# EasyEDA Pro project BLDCV6.eprj, board PCB1_1
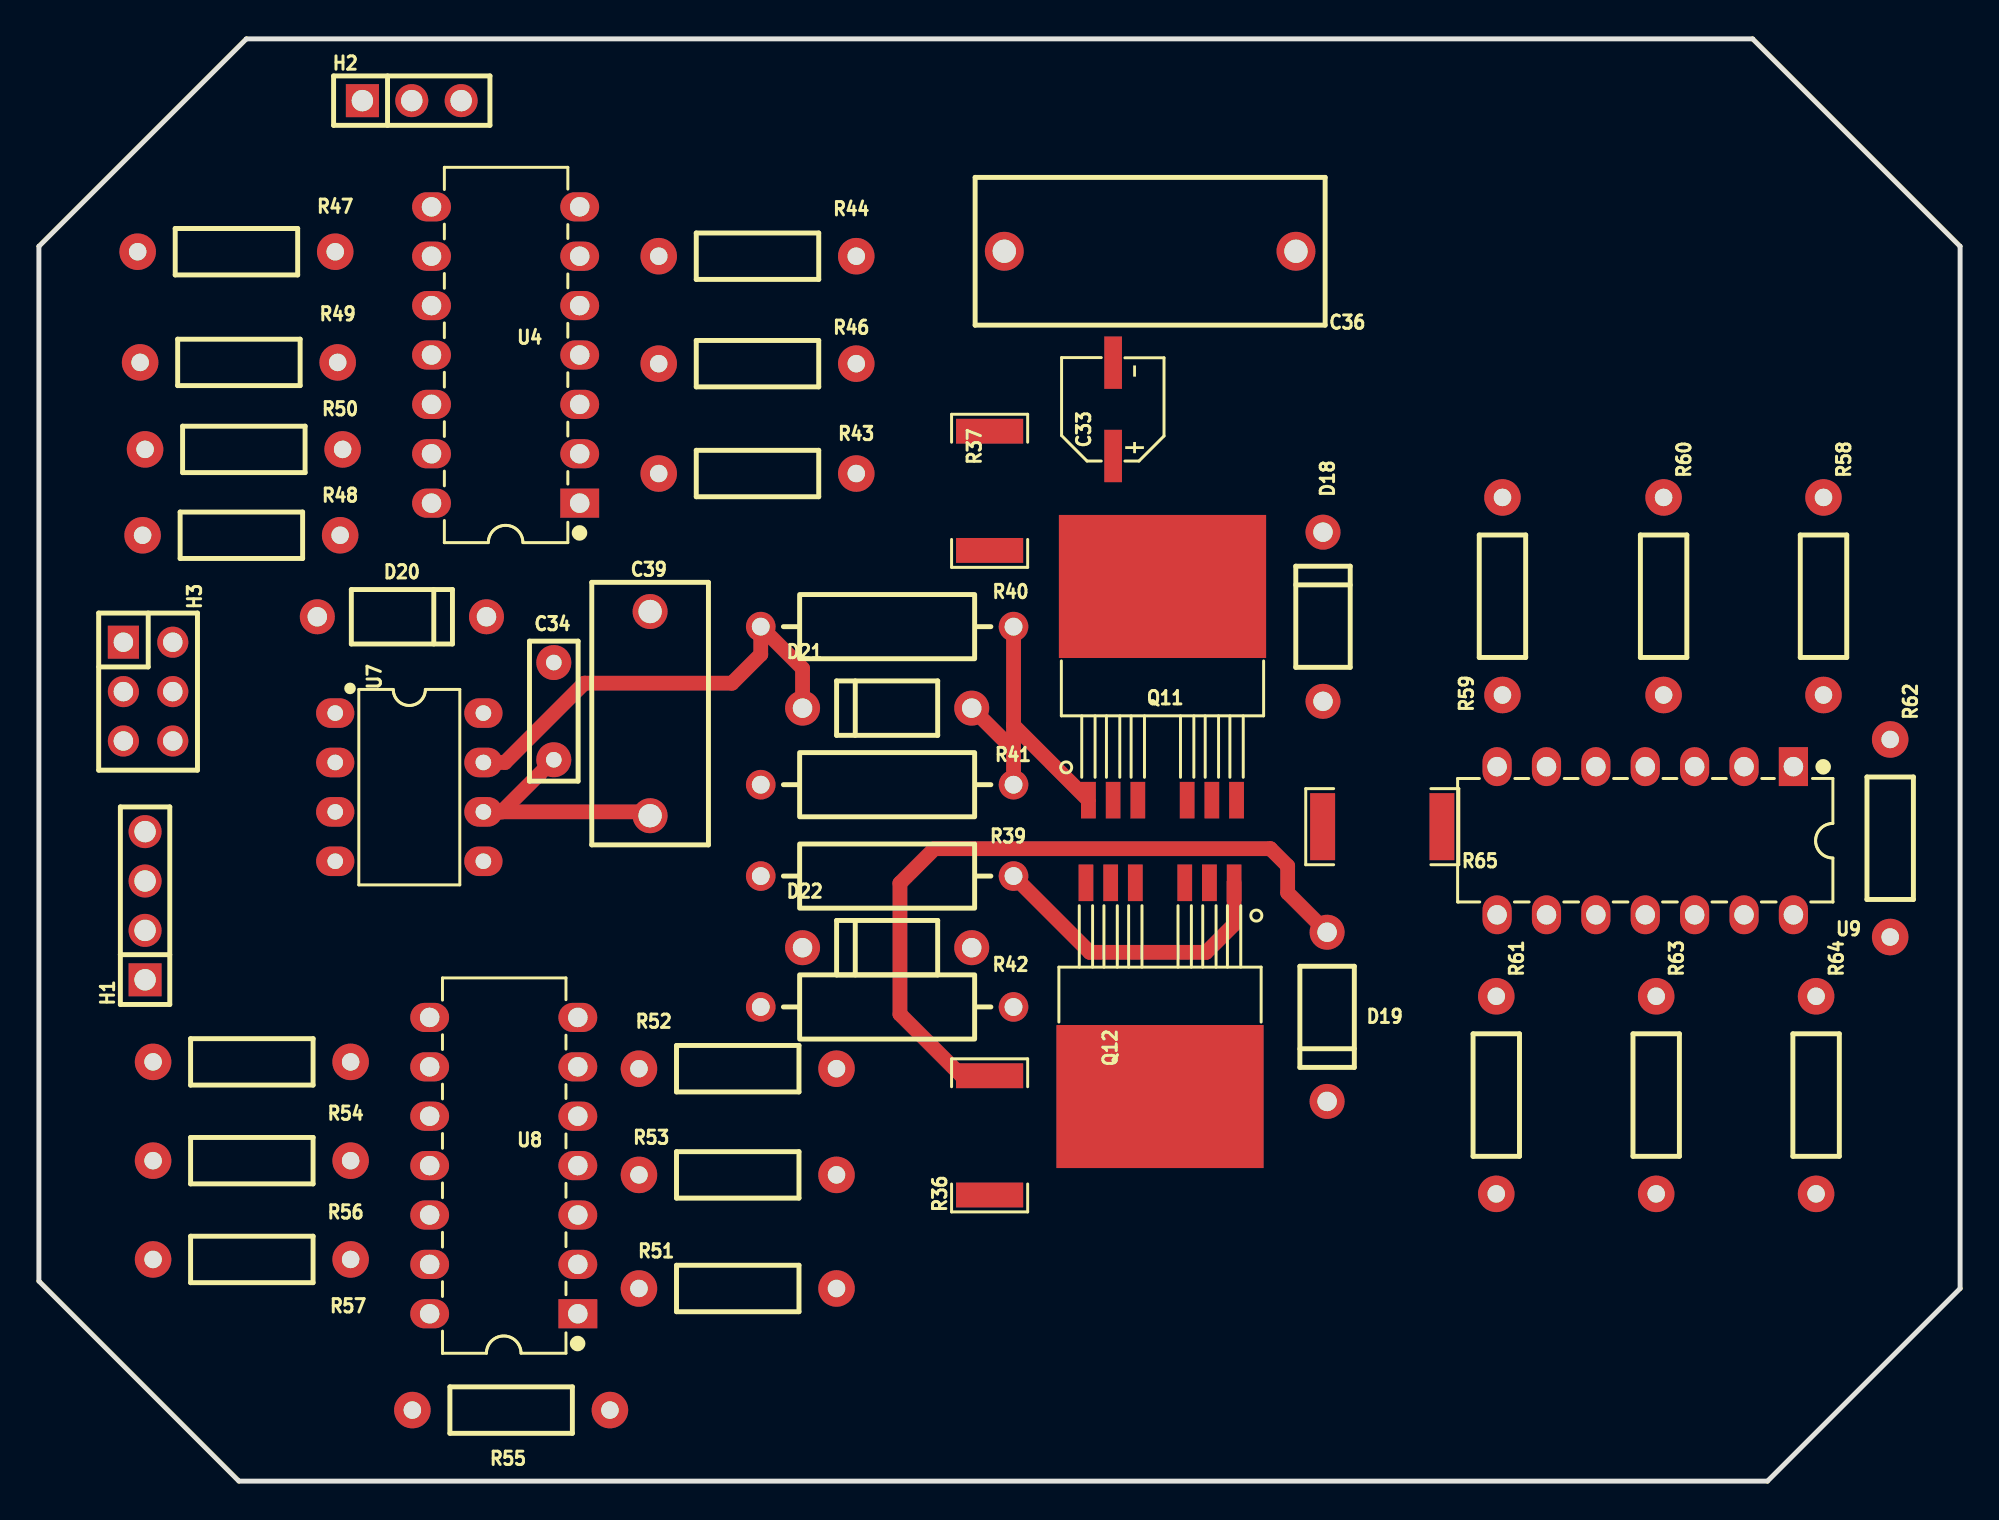
[diagram p15: board, top side]
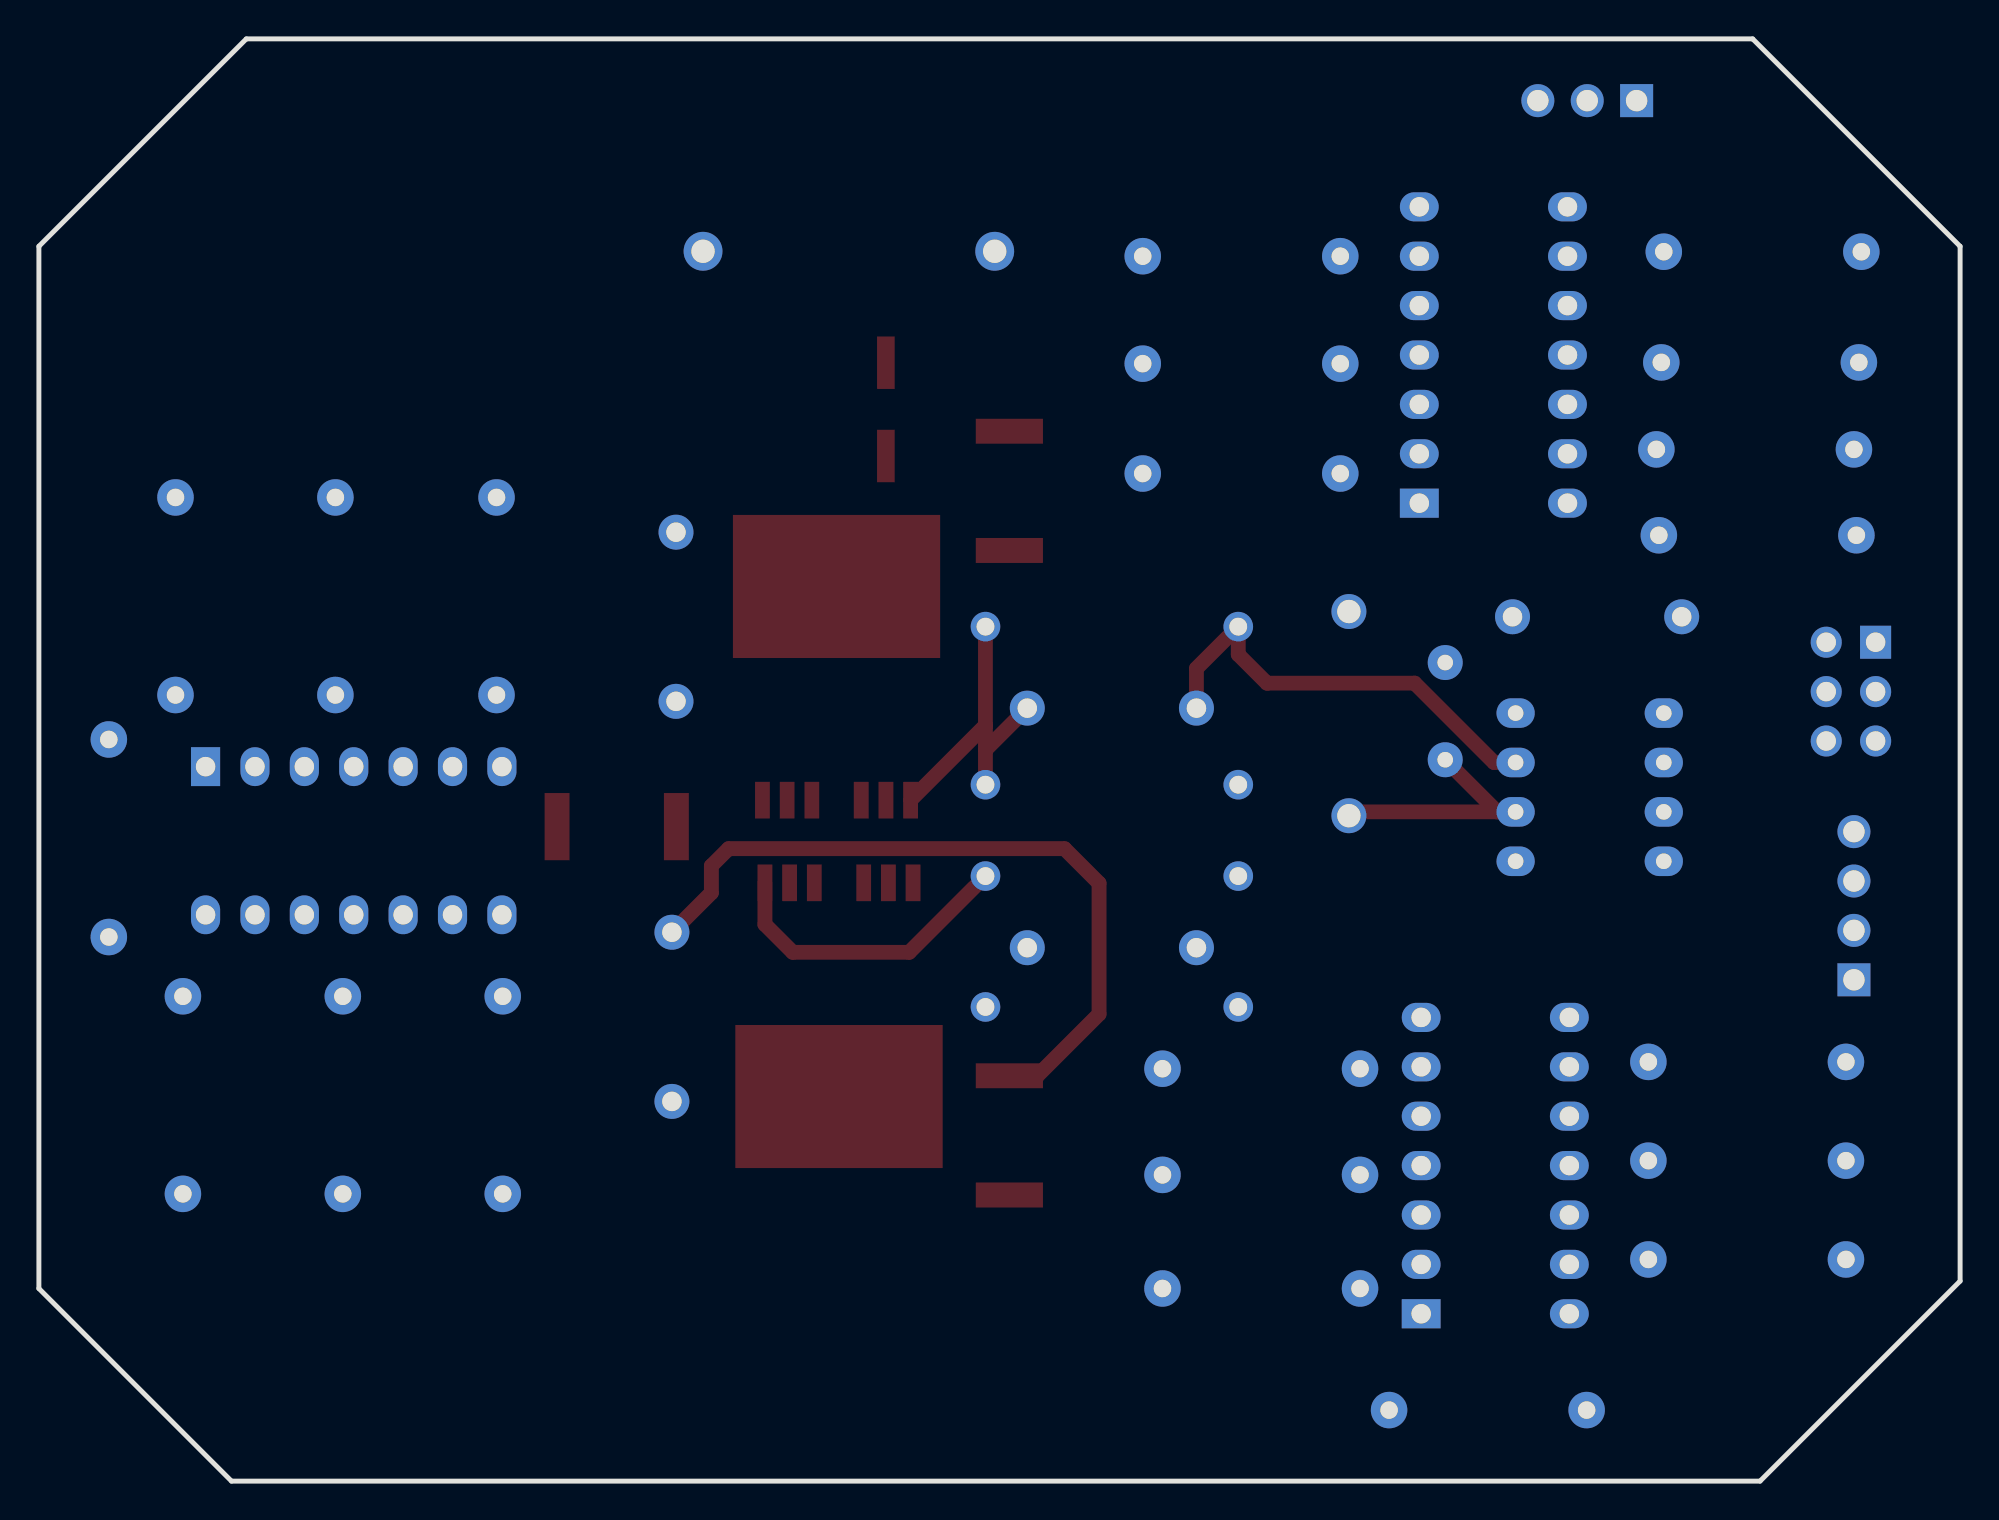
[diagram p16: board, bottom side, seen from below]

Outline 98.81 x 74.17 mm; copper layers: Top Layer, GND, Inner2, Bottom Layer. Coordinates in mm from the lower left corner of the outline.
Outline path: 0,63.5 0,10.29 10.29,0 88.9,0 98.81,9.91 98.81,63.5 88.14,74.17 10.67,74.17 0,63.5
Stack: Top Layer 0.035mm 外层铜厚1oz / Dielectric1 0.2104mm 7628 RC49% 8.6mil / GND 0.0152mm 内层铜厚 / Dielectric2 1.065mm 1.1mm H/HOZ 含铜 / Inner2 0.0152mm 内层铜厚 / Dielectric3 0.2104mm 7628 RC49% 8.6mil / Bottom Layer 0.035mm 外层铜厚1oz

## Design rules (mm)
template: JLCPCB Capability(Two Layers Board)
spacing copperThickness1oz (default): track to track 0.102, other pairs 0.152 to 0.3
spacing copperThickness2oz: track to track 0.203, other pairs 0.152 to 0.3
track width copperThickness1oz (default): min 0.127, default 0.254, max 2.54
track width copperThickness2oz: min 0.203, default 0.254, max 2.54
differential pair differentialPair (default): width min 0.127, default 0.254, max 2.54; gap min 0.152, default 0.152
via viaSize (default): diameter min 0.5, default 0.61, max 10; hole min 0.3, default 0.305, max 6.3

## Placement (name value [footprint] x y rotation side)
C33  10uF  [CAP-SMD_BD5.0-L5.3-W5.3-LS6.3-FD]  55.24 55.12 90 top
C34  1uF  [CAP-TH_L7.2-W2.5-P5.00-D0.6]  26.48 39.6 90 top
C36  330nF  [CAP-TH_L18.0-W7.5-P15.00-D0.8]  57.15 63.25 180 top
C39  15nF  [CAP-TH_L13.5-W5.5-P10.50-D1.2]  31.43 39.47 90 top
D18  -  [DO-41_BD2.4-L4.7-P8.70-D0.9-RD]  66.04 44.45 270 top
D19  -  [DO-41_BD2.4-L4.7-P8.70-D0.9-RD]  66.25 23.88 90 top
D20  -  [DO-41_BD2.4-L4.7-P8.70-D0.9-RD]  18.67 44.45 180 top
D21  -  [DO-41_BD2.4-L4.7-P8.70-D0.9-RD]  43.62 39.75 0 top
D22  -  [DO-41_BD2.4-L4.7-P8.70-D0.9-RD]  43.62 27.43 0 top
H1  -  [HDR-TH_4P-P2.54-V-M]  5.46 29.59 90 top
H2  -  [HDR-TH_3P-P2.54-V-M]  19.18 70.99 0 top
H3  -  [HDR-TH_6P-P2.54-V-F-R2-C3-S2.54]  5.62 40.6 270 top
Q11  IRFS7530TRL7PP  [D2PAK-7_L10.6-W9.6-P1.27-LS15.9-BR]  57.79 40.51 270 top
Q12  IRFS7530TRL7PP  [D2PAK-7_L10.6-W9.6-P1.27-LS15.9-BR]  57.66 25.27 90 top
R36  5mΩ  [R2512]  48.89 17.78 90 top
R37  5mΩ  [R2512]  48.89 50.93 90 top
R39  [6-10]  [RES-TH_BD3.3-L9.0-P13.00-D0.6]  43.62 31.11 0 top
R40  [6-10]  [RES-TH_BD3.3-L9.0-P13.00-D0.6]  43.62 43.94 180 top
R41  10k  [RES-TH_BD3.3-L9.0-P13.00-D0.6]  43.62 35.81 180 top
R42  10k  [RES-TH_BD3.3-L9.0-P13.00-D0.6]  43.62 24.38 180 top
R43  10kΩ  [R_AXIAL-0.4]  36.96 51.82 180 top
R44  10kΩ  [R_AXIAL-0.4]  36.96 62.99 180 top
R46  10kΩ  [R_AXIAL-0.4]  36.96 57.47 0 top
R47  10kΩ  [R_AXIAL-0.4]  10.16 63.22 0 top
R48  10kΩ  [R_AXIAL-0.4]  10.41 48.64 180 top
R49  10kΩ  [R_AXIAL-0.4]  10.29 57.53 180 top
R50  10kΩ  [R_AXIAL-0.4]  10.54 53.06 180 top
R51  10kΩ  [R_AXIAL-0.4]  35.94 9.91 0 top
R52  10kΩ  [R_AXIAL-0.4]  35.94 21.21 180 top
R53  10kΩ  [R_AXIAL-0.4]  35.94 15.75 0 top
R54  10kΩ  [R_AXIAL-0.4]  10.95 21.56 180 top
R55  10kΩ  [R_AXIAL-0.4]  24.29 3.65 180 top
R56  10kΩ  [R_AXIAL-0.4]  10.95 16.48 180 top
R57  10kΩ  [R_AXIAL-0.4]  10.95 11.4 180 top
R58  10kΩ  [R_AXIAL-0.4]  91.78 45.51 270 top
R59  10kΩ  [R_AXIAL-0.4]  75.27 45.51 90 top
R60  10kΩ  [R_AXIAL-0.4]  83.56 45.51 270 top
R61  10kΩ  [R_AXIAL-0.4]  74.95 19.85 270 top
R62  10kΩ  [R_AXIAL-0.4]  95.21 33.06 270 top
R63  10kΩ  [R_AXIAL-0.4]  83.18 19.85 270 top
R64  10kΩ  [R_AXIAL-0.4]  91.4 19.85 270 top
R65  5mΩ  [R2512]  69.09 33.65 180 top
U4  LM324N  [DIP-14_L19.3-W7.0-P2.54-LS7.6-BL]  24 57.91 90 top
U7  IR2104PBF  [DIP-8_L9.9-W6.6-P2.54-LS7.62-BL]  19.05 35.69 270 top
U8  LM324N  [DIP-14_L19.3-W7.0-P2.54-LS7.6-BL]  23.91 16.23 90 top
U9  LM324N  [DIP-14_L19.3-W7.0-P2.54-LS7.6-BL]  82.61 32.93 180 top

## Footprints (pads in the part's own frame, mm; a bottom-side part is the same pattern mirrored in y, then rotated)
CAP-SMD_BD5.0-L5.3-W5.3-LS6.3-FD
  rect 2.7x0.91 smd: 1(-2.4,0) 2(2.4,0)
CAP-TH_L7.2-W2.5-P5.00-D0.6
  round 1.8 hole 0.8: 1(-2.499,0) 2(2.499,0)
CAP-TH_L13.5-W5.5-P10.50-D1.2
  round 1.8 hole 1.2: 1(-5.25,0) 2(5.25,0)
CAP-TH_L18.0-W7.5-P15.00-D0.8
  round 2 hole 1.2: 1(-7.5,0) 2(7.5,0)
D2PAK-7_L10.6-W9.6-P1.27-LS15.9-BR
  rect 1.887x0.762 smd: 1(5.495,-3.81) 2(5.495,-2.54) 3(5.495,-1.27) 5(5.495,1.27) 6(5.495,2.54) 7(5.495,3.81)
  rect 7.356x10.66 smd: 4(-5.495,0)
DIP-8_L9.9-W6.6-P2.54-LS7.62-BL
  oval 1.524x1.97 hole 0.8: 1(-3.81,-3.81) 2(-1.27,-3.81) 3(1.27,-3.81) 4(3.81,-3.81) 5(3.81,3.81) 6(1.27,3.81) 7(-1.27,3.81) 8(-3.81,3.81)
DIP-14_L19.3-W7.0-P2.54-LS7.6-BL
  rect 1.5x2 hole 1: 1(-7.62,-3.81)
  oval 1.5x2 hole 1: 2(-5.08,-3.81) 3(-2.54,-3.81) 4(0,-3.81) 5(2.54,-3.81) 6(5.08,-3.81) 7(7.62,-3.81) 8(7.62,3.81) 9(5.08,3.81) 10(2.54,3.81) 11(0,3.81) 12(-2.54,3.81) 13(-5.08,3.81) 14(-7.62,3.81)
DO-41_BD2.4-L4.7-P8.70-D0.9-RD
  round 1.8 hole 1: 1(-4.35,0) 2(4.35,0)
HDR-TH_3P-P2.54-V-M
  rect 1.7x1.7 hole 1.1: 1(-2.54,0)
  round 1.7 hole 1.1: 2(0,0) 3(2.54,0)
HDR-TH_4P-P2.54-V-M
  rect 1.7x1.7 hole 1.1: 1(-3.81,0)
  round 1.7 hole 1.1: 2(-1.27,0) 3(1.27,0) 4(3.81,0)
HDR-TH_6P-P2.54-V-F-R2-C3-S2.54
  rect 1.7x1.6 hole 1: 1(-2.54,-1.27)
  round 1.6 hole 1: 2(-2.54,1.27) 3(0,-1.27) 4(0,1.27) 5(2.54,-1.27) 6(2.54,1.27)
R2512
  rect 1.282x3.456 smd: 1(-3.067,0) 2(3.067,0)
R_AXIAL-0.4
  round 1.879 hole 0.899: 1(-5.08,0) 2(5.08,0)
RES-TH_BD3.3-L9.0-P13.00-D0.6
  round 1.524 hole 0.914: 1(-6.5,0) 2(6.5,0)

## Nets
12V: H2.3
+5V: U4.4 U8.4 U9.4
GND: C33.2 C36.1 R36.1 R41.2 R42.2 R49.2 R56.2 R63.2 U4.5 U7.4 U8.5 U9.5
VCC: C33.1 C36.2 H2.1 R37.2
HIN: H1.4 U7.2
HS1_SENSE: D18.1 Q11.4 R37.1 U4.3
HSO: D21.1 R40.2 U7.7
LOW_RAIL: U4.11 U8.11 U9.11
LS1_SENSE: D19.2 Q12.2 Q12.3 Q12.5 Q12.6 Q12.7 R36.2 U8.3
LSO: D22.1 R39.1 U7.5
SD#: H1.3 U7.3
SWITCH_NODE: D18.2 D19.1 Q11.2 Q11.3 Q11.5 Q11.6 Q11.7 Q12.4 R65.2
$1N6799: C34.2 C39.2 D20.1 U7.8
$1N6801: C34.1 C39.1 U7.6
$1N9323: R43.2 U4.1
$1N9349: R44.1 U4.7
$1N9578: R44.2 R46.1 R47.1 U4.6
$1N9592: R43.1 R46.2 R48.1 U4.2
$1N9659: R47.2 R49.1 U4.12
$1N9766: R48.2 R50.2 U4.13
$1N10683: R51.2 U8.1
$1N10684: R52.1 U8.7
$1N10685: R52.2 R53.1 R54.1 U8.6
$1N10686: R51.1 R53.2 R55.1 U8.2
$1N10689: R54.2 R56.1 U8.12
$1N10692: R55.2 R57.2 U8.13
$1N10984: R58.2 U9.1
$1N10985: R59.1 U9.7
$1N10986: R59.2 R60.1 R61.1 U9.6
$1N10987: R58.1 R60.2 R62.1 U9.2
$1N10990: R61.2 R63.1 U9.12
$1N10993: R62.2 R64.2 U9.13
$1N11070: R65.1 U9.3
$1N11983: D20.2 H2.2 U7.1
$1N12138: H3.1 R50.1 U4.14
$1N12148: H3.3 R57.1 U8.14
$1N12156: H3.5 R64.1 U9.14
$1N12196: D21.2 Q11.1 R40.1 R41.1
$1N12225: D22.2 Q12.1 R39.2 R42.1

Pads without a net: H1 1 2; H3 2 4 6; U4 8 9 10; U8 8 9 10; U9 8 9 10

## Routing (per net, layer and track width the routed paths; a pad name or vN(x,y) marks a point on that pad's centre or on a via; arc(x,y) is an arc through that point)
HSO: length 23.1
  Top Layer w0.762: U7.7 23.97,36.96 28.05,41.03 35.65,41.03 37.12,42.51 R40.2 39.27,41.79 D21.1
LS1_SENSE: length 38
  Top Layer w0.762: D19.2 64.22,30.26 64.22,31.64 63.33,32.53 46.06,32.53 44.28,30.75 44.28,24.02 47.45,20.85 R36.2
$1N6801: length 12.4
  Top Layer w0.762: 23.8,34.42 C34.1 ; 23.8,34.42 31.24,34.42 C39.1 ; 23.8,34.42 U7.6
$1N12196: length 16.6
  Top Layer w0.762: R41.1 50.12,37.6 ; 50.12,37.6 50.12,38.87 ; 50.12,37.6 D21.2 ; 50.12,38.87 Q11.1 ; 50.12,38.87 R40.1
$1N12225: length 15.7
  Top Layer w0.762: R39.2 54.05,27.19 60.03,27.19 61.47,28.63 Q12.1
